# EasyEDA Pro project kuafu01_030内部老化方案.eprj, board PCB4 (continued)
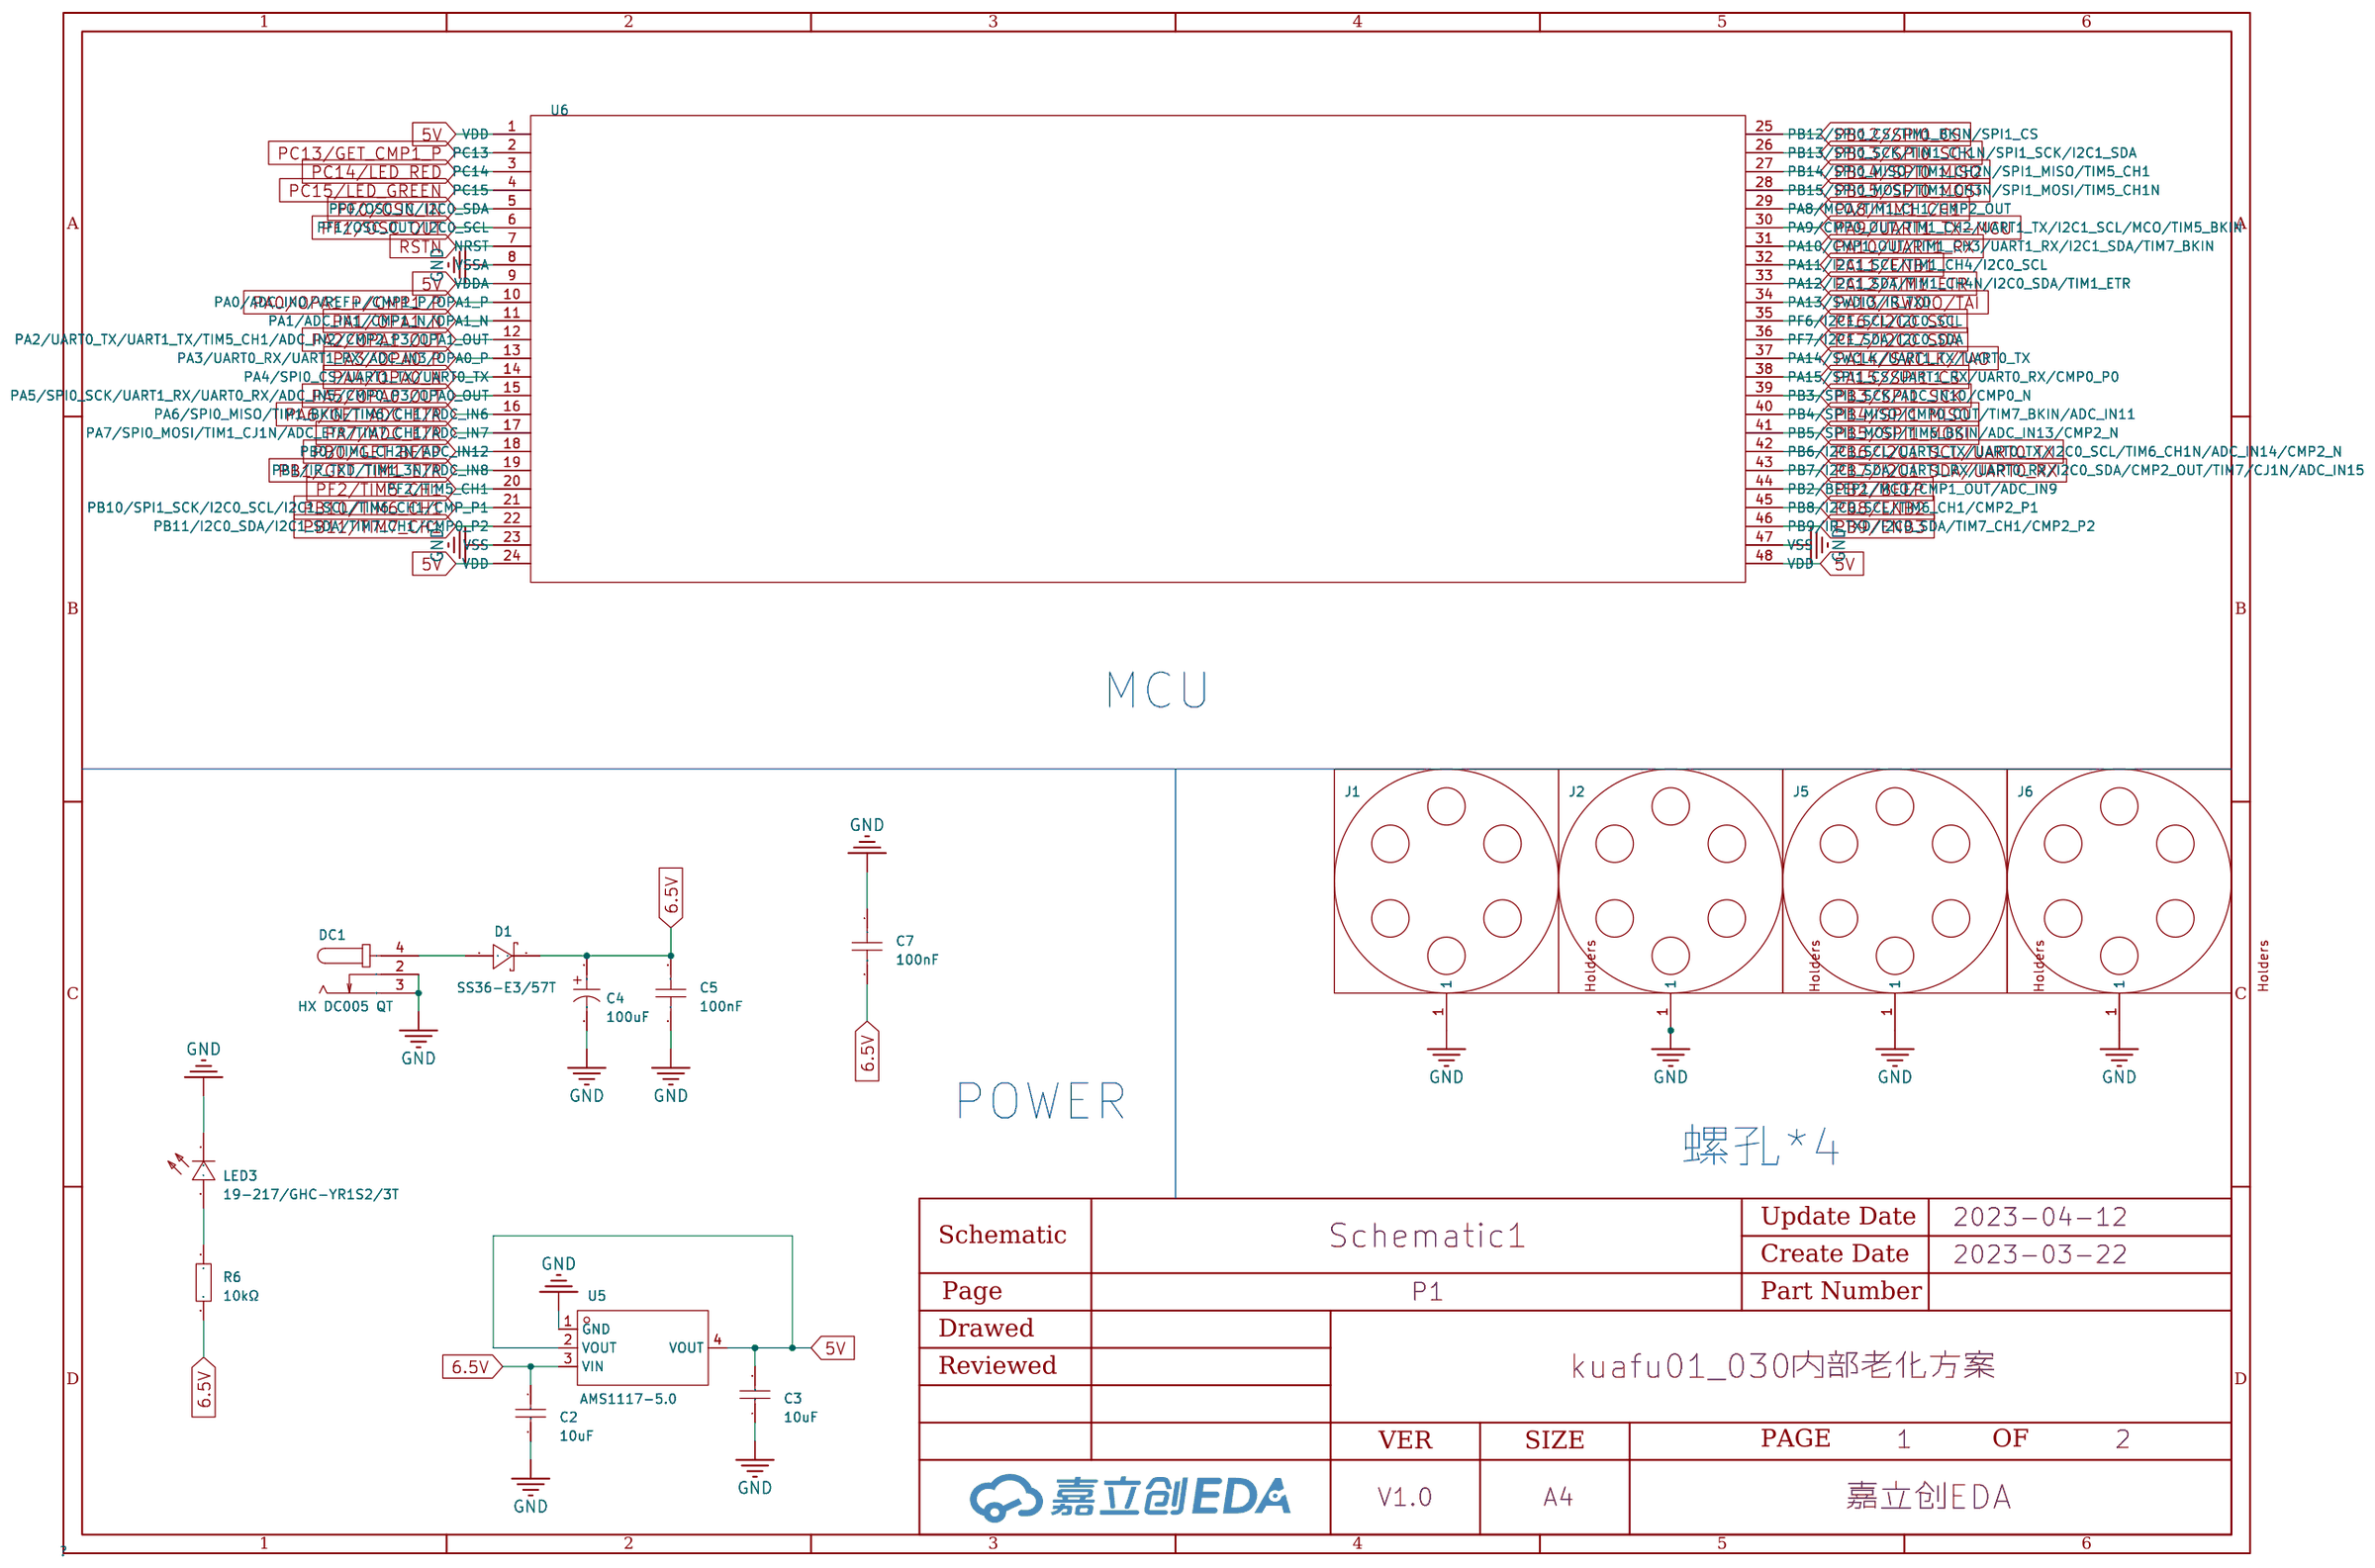
[diagram p0: P1]
## Routing (per net, layer and track width the routed paths; a pad name or vN(x,y) marks a point on that pad's centre or on a via; arc(x,y) is an arc through that point) (continued)
  vias: v1(27.43,288.04) v1(27.43,287.27) v1(27.43,286.51) v1(27.43,281.94) v1(27.43,281.18) v1(27.43,280.42) v1(27.43,274.32) v1(27.43,273.56) v1(27.43,272.8) v1(27.43,237.24) v1(27.43,236.47) v1(27.43,235.71) v1(27.43,231.14) v1(27.43,230.38) v1(27.43,229.62) v1(27.43,223.52) v1(27.43,222.76) v1(27.43,222) v1(27.43,186.44) v1(27.43,185.67) v1(27.43,184.91) v1(27.43,180.34) v1(27.43,179.58) v1(27.43,178.82) v1(27.43,172.72) v1(27.43,171.96) v1(27.43,171.2) v1(27.43,135.64) v1(27.43,134.87) v1(27.43,134.11) v1(27.43,129.54) v1(27.43,128.78) v1(27.43,128.02) v1(27.43,121.92) v1(27.43,121.16) v1(27.43,120.4) v1(27.43,84.84) v1(27.43,84.07) v1(27.43,83.31) v1(27.43,78.74) v1(27.43,77.98) v1(27.43,77.22) v1(27.43,71.12) v1(27.43,70.36) v1(27.43,69.6) v1(27.43,34.04) v1(27.43,33.27) v1(27.43,32.51) v1(27.43,27.94) v1(27.43,27.18) v1(27.43,26.42) v1(27.43,20.32) v1(27.43,19.56) v1(27.43,18.8) v1(28.19,288.04) v1(28.19,287.27) v1(28.19,286.51) v1(28.19,281.94) v1(28.19,281.18) v1(28.19,280.42) v1(28.19,274.32) v1(28.19,273.56) v1(28.19,272.8) v1(28.19,237.24) v1(28.19,236.47) v1(28.19,235.71) v1(28.19,231.14) v1(28.19,230.38) v1(28.19,229.62) v1(28.19,223.52) v1(28.19,222.76) v1(28.19,222) v1(28.19,186.44) v1(28.19,185.67) v1(28.19,184.91) v1(28.19,180.34) v1(28.19,179.58) v1(28.19,178.82) v1(28.19,172.72) v1(28.19,171.96) v1(28.19,171.2) v1(28.19,135.64) v1(28.19,134.87) v1(28.19,134.11) v1(28.19,129.54) v1(28.19,128.78) v1(28.19,128.02) v1(28.19,121.92) v1(28.19,121.16) v1(28.19,120.4) v1(28.19,84.84) v1(28.19,84.07) v1(28.19,83.31) v1(28.19,78.74) v1(28.19,77.98) v1(28.19,77.22) v1(28.19,71.12) v1(28.19,70.36) v1(28.19,69.6) v1(28.19,34.04) v1(28.19,33.27) v1(28.19,32.51) v1(28.19,27.94) v1(28.19,27.18) v1(28.19,26.42) v1(28.19,20.32) v1(28.19,19.56) v1(28.19,18.8) v1(28.96,288.04) v1(28.96,287.27) v1(28.96,286.51) v1(28.96,281.94) v1(28.96,281.18) v1(28.96,280.42) v1(28.96,274.32) v1(28.96,273.56) v1(28.96,272.8) v1(28.96,237.24) v1(28.96,236.47) v1(28.96,235.71) v1(28.96,231.14) v1(28.96,230.38) v1(28.96,229.62) v1(28.96,223.52) v1(28.96,222.76) v1(28.96,222) v1(28.96,186.44) v1(28.96,185.67) v1(28.96,184.91) v1(28.96,180.34) v1(28.96,179.58) v1(28.96,178.82) v1(28.96,172.72) v1(28.96,171.96) v1(28.96,171.2) v1(28.96,135.64) v1(28.96,134.87) v1(28.96,134.11) v1(28.96,129.54) v1(28.96,128.78) v1(28.96,128.02) v1(28.96,121.92) v1(28.96,121.16) v1(28.96,120.4) v1(28.96,84.84) v1(28.96,84.07) v1(28.96,83.31) v1(28.96,78.74) v1(28.96,77.98) v1(28.96,77.22) v1(28.96,71.12) v1(28.96,70.36) v1(28.96,69.6) v1(28.96,34.04) v1(28.96,33.27) v1(28.96,32.51) v1(28.96,27.94) v1(28.96,27.18) v1(28.96,26.42) v1(28.96,20.32) v1(28.96,19.56) v1(28.96,18.8) v1(29.46,295.15) v1(29.46,294.39) v1(29.46,293.62) v1(29.46,244.35) v1(29.46,243.59) v1(29.46,242.82) v1(29.46,193.55) v1(29.46,192.79) v1(29.46,192.02) v1(29.46,142.75) v1(29.46,141.99) v1(29.46,141.22) v1(29.46,91.95) v1(29.46,91.19) v1(29.46,90.42) v1(29.46,41.15) v1(29.46,40.39) v1(29.46,39.62) v1(30.23,295.15) v1(30.23,294.39) v1(30.23,293.62) v1(30.23,244.35) v1(30.23,243.59) v1(30.23,242.82) v1(30.23,193.55) v1(30.23,192.79) v1(30.23,192.02) v1(30.23,142.75) v1(30.23,141.99) v1(30.23,141.22) v1(30.23,91.95) v1(30.23,91.19) v1(30.23,90.42) v1(30.23,41.15) v1(30.23,40.39) v1(30.23,39.62) v1(30.99,301.24) v1(30.99,300.48) v1(30.99,299.72) v1(30.99,295.15) v1(30.99,294.39) v1(30.99,293.62) v1(30.99,250.44) v1(30.99,249.68) v1(30.99,248.92) v1(30.99,244.35) v1(30.99,243.59) v1(30.99,242.82) v1(30.99,199.64) v1(30.99,198.88) v1(30.99,198.12) v1(30.99,193.55) v1(30.99,192.79) v1(30.99,192.02) v1(30.99,148.84) v1(30.99,148.08) v1(30.99,147.32) v1(30.99,142.75) v1(30.99,141.99) v1(30.99,141.22) v1(30.99,98.04) v1(30.99,97.28) v1(30.99,96.52) v1(30.99,91.95) v1(30.99,91.19) v1(30.99,90.42) v1(30.99,47.24) v1(30.99,46.48) v1(30.99,45.72) v1(30.99,41.15) v1(30.99,40.39) v1(30.99,39.62) v1(31.75,301.24) v1(31.75,300.48) v1(31.75,299.72) v1(31.75,250.44) v1(31.75,249.68) v1(31.75,248.92) v1(31.75,199.64) v1(31.75,198.88) v1(31.75,198.12) v1(31.75,148.84) v1(31.75,148.08) v1(31.75,147.32) v1(31.75,98.04) v1(31.75,97.28) v1(31.75,96.52) v1(31.75,47.24) v1(31.75,46.48) v1(31.75,45.72) v1(32.51,301.24) v1(32.51,300.48) v1(32.51,299.72) v1(32.51,250.44) v1(32.51,249.68) v1(32.51,248.92) v1(32.51,199.64) v1(32.51,198.88) v1(32.51,198.12) v1(32.51,148.84) v1(32.51,148.08) v1(32.51,147.32) v1(32.51,98.04) v1(32.51,97.28) v1(32.51,96.52) v1(32.51,47.24) v1(32.51,46.48) v1(32.51,45.72) v1(33.02,307.34) v1(33.02,306.58) v1(33.02,305.82) v1(33.02,268.22) v1(33.02,267.46) v1(33.02,266.7) v1(33.02,256.54) v1(33.02,255.78) v1(33.02,255.02) v1(33.02,217.42) v1(33.02,216.66) v1(33.02,215.9) v1(33.02,205.74) v1(33.02,204.98) v1(33.02,204.22) v1(33.02,166.62) v1(33.02,165.86) v1(33.02,165.1) v1(33.02,154.94) v1(33.02,154.18) v1(33.02,153.42) v1(33.02,115.82) v1(33.02,115.06) v1(33.02,114.3) v1(33.02,104.14) v1(33.02,103.38) v1(33.02,102.62) v1(33.02,65.02) v1(33.02,64.26) v1(33.02,63.5) v1(33.02,53.34) v1(33.02,52.58) v1(33.02,51.82) v1(33.02,14.22) v1(33.02,13.46) v1(33.02,12.7) v1(33.78,307.34) v1(33.78,306.58) v1(33.78,305.82) v1(33.78,268.22) v1(33.78,267.46) v1(33.78,266.7) v1(33.78,256.54) v1(33.78,255.78) v1(33.78,255.02) v1(33.78,217.42) v1(33.78,216.66) v1(33.78,215.9) v1(33.78,205.74) v1(33.78,204.98) v1(33.78,204.22) v1(33.78,166.62) v1(33.78,165.86) v1(33.78,165.1) v1(33.78,154.94) v1(33.78,154.18) v1(33.78,153.42) v1(33.78,115.82) v1(33.78,115.06) v1(33.78,114.3) v1(33.78,104.14) v1(33.78,103.38) v1(33.78,102.62) v1(33.78,65.02) v1(33.78,64.26) v1(33.78,63.5) v1(33.78,53.34) v1(33.78,52.58) v1(33.78,51.82) v1(33.78,14.22) v1(33.78,13.46) v1(33.78,12.7) v1(34.54,307.34) v1(34.54,306.58) v1(34.54,305.82) v1(34.54,268.22) v1(34.54,267.46) v1(34.54,266.7) v1(34.54,256.54) v1(34.54,255.78) v1(34.54,255.02) v1(34.54,217.42) v1(34.54,216.66) v1(34.54,215.9) v1(34.54,205.74) v1(34.54,204.98) v1(34.54,204.22) v1(34.54,166.62) v1(34.54,165.86) v1(34.54,165.1) v1(34.54,154.94) v1(34.54,154.18) v1(34.54,153.42) v1(34.54,115.82) v1(34.54,115.06) v1(34.54,114.3) v1(34.54,104.14) v1(34.54,103.38) v1(34.54,102.62) v1(34.54,65.02) v1(34.54,64.26) v1(34.54,63.5) v1(34.54,53.34) v1(34.54,52.58) v1(34.54,51.82) v1(34.54,14.22) v1(34.54,13.46) v1(34.54,12.7) v1(62.99,307.34) v1(62.99,306.58) v1(62.99,305.82) v1(62.99,268.22) v1(62.99,267.46) v1(62.99,266.7) v1(62.99,256.54) v1(62.99,255.78) v1(62.99,255.02) v1(62.99,217.42) v1(62.99,216.66) v1(62.99,215.9) v1(62.99,205.74) v1(62.99,204.98) v1(62.99,204.22) v1(62.99,166.62) v1(62.99,165.86) v1(62.99,165.1) v1(62.99,154.94) v1(62.99,154.18) v1(62.99,153.42) v1(62.99,115.82) v1(62.99,115.06) v1(62.99,114.3) v1(62.99,104.14) v1(62.99,103.38) v1(62.99,102.62) v1(62.99,65.02) v1(62.99,64.26) v1(62.99,63.5) v1(62.99,53.34) v1(62.99,52.58) v1(62.99,51.82) v1(62.99,14.22) v1(62.99,13.46) v1(62.99,12.7) v1(63.75,307.34) v1(63.75,306.58) v1(63.75,305.82) v1(63.75,268.22) v1(63.75,267.46) v1(63.75,266.7) v1(63.75,256.54) v1(63.75,255.78) v1(63.75,255.02) v1(63.75,217.42) v1(63.75,216.66) v1(63.75,215.9) v1(63.75,205.74) v1(63.75,204.98) v1(63.75,204.22) v1(63.75,166.62) v1(63.75,165.86) v1(63.75,165.1) v1(63.75,154.94) v1(63.75,154.18) v1(63.75,153.42) v1(63.75,115.82) v1(63.75,115.06) v1(63.75,114.3) v1(63.75,104.14) v1(63.75,103.38) v1(63.75,102.62) v1(63.75,65.02) v1(63.75,64.26) v1(63.75,63.5) v1(63.75,53.34) v1(63.75,52.58) v1(63.75,51.82) v1(63.75,14.22) v1(63.75,13.46) v1(63.75,12.7) v1(64.52,307.34) v1(64.52,306.58) v1(64.52,305.82) v1(64.52,268.22) v1(64.52,267.46) v1(64.52,266.7) v1(64.52,256.54) v1(64.52,255.78) v1(64.52,255.02) v1(64.52,217.42) v1(64.52,216.66) v1(64.52,215.9) v1(64.52,205.74) v1(64.52,204.98) v1(64.52,204.22) v1(64.52,166.62) v1(64.52,165.86) v1(64.52,165.1) v1(64.52,154.94) v1(64.52,154.18) v1(64.52,153.42) v1(64.52,115.82) v1(64.52,115.06) v1(64.52,114.3) v1(64.52,104.14) v1(64.52,103.38) v1(64.52,102.62) v1(64.52,65.02) v1(64.52,64.26) v1(64.52,63.5) v1(64.52,53.34) v1(64.52,52.58) v1(64.52,51.82) v1(64.52,14.22) v1(64.52,13.46) v1(64.52,12.7) v1(65.53,301.24) v1(65.53,300.48) v1(65.53,299.72) v1(65.53,250.44) v1(65.53,249.68) v1(65.53,248.92) v1(65.53,199.64) v1(65.53,198.88) v1(65.53,198.12) v1(65.53,148.84) v1(65.53,148.08) v1(65.53,147.32) v1(65.53,98.04) v1(65.53,97.28) v1(65.53,96.52) v1(65.53,47.24) v1(65.53,46.48) v1(65.53,45.72) v1(66.29,301.24) v1(66.29,300.48) v1(66.29,299.72) v1(66.29,250.44) v1(66.29,249.68) v1(66.29,248.92) v1(66.29,199.64) v1(66.29,198.88) v1(66.29,198.12) v1(66.29,148.84) v1(66.29,148.08) v1(66.29,147.32) v1(66.29,98.04) v1(66.29,97.28) v1(66.29,96.52) v1(66.29,47.24) v1(66.29,46.48) v1(66.29,45.72) v1(67.06,301.24) v1(67.06,300.48) v1(67.06,299.72) v1(67.06,250.44) v1(67.06,249.68) v1(67.06,248.92) v1(67.06,199.64) v1(67.06,198.88) v1(67.06,198.12) v1(67.06,148.84) v1(67.06,148.08) v1(67.06,147.32) v1(67.06,98.04) v1(67.06,97.28) v1(67.06,96.52) v1(67.06,47.24) v1(67.06,46.48) v1(67.06,45.72) v1(68.58,295.15) v1(68.58,294.39) v1(68.58,293.62) v1(68.58,272.8) v1(68.58,272.03) v1(68.58,271.27) v1(68.58,244.35) v1(68.58,243.59) v1(68.58,242.82) v1(68.58,222) v1(68.58,221.23) v1(68.58,220.47) v1(68.58,193.55) v1(68.58,192.79) v1(68.58,192.02) v1(68.58,171.2) v1(68.58,170.43) v1(68.58,169.67) v1(68.58,142.75) v1(68.58,141.99) v1(68.58,141.22) v1(68.58,120.4) v1(68.58,119.63) v1(68.58,118.87) v1(68.58,91.95) v1(68.58,91.19) v1(68.58,90.42) v1(68.58,69.6) v1(68.58,68.83) v1(68.58,68.07) v1(68.58,41.15) v1(68.58,40.39) v1(68.58,39.62) v1(68.58,18.8) v1(68.58,18.03) v1(68.58,17.27) v1(69.34,295.15) v1(69.34,294.39) v1(69.34,293.62) v1(69.34,272.8) v1(69.34,272.03) v1(69.34,271.27) v1(69.34,244.35) v1(69.34,243.59) v1(69.34,242.82) v1(69.34,222) v1(69.34,221.23) v1(69.34,220.47) v1(69.34,193.55) v1(69.34,192.79) v1(69.34,192.02) v1(69.34,171.2) v1(69.34,170.43) v1(69.34,169.67) v1(69.34,142.75) v1(69.34,141.99) v1(69.34,141.22) v1(69.34,120.4) v1(69.34,119.63) v1(69.34,118.87) v1(69.34,91.95) v1(69.34,91.19) v1(69.34,90.42) v1(69.34,69.6) v1(69.34,68.83) v1(69.34,68.07) v1(69.34,41.15) v1(69.34,40.39) v1(69.34,39.62) v1(69.34,18.8) v1(69.34,18.03) v1(69.34,17.27) v1(70.1,295.15) v1(70.1,294.39) v1(70.1,293.62) v1(70.1,272.8) v1(70.1,272.03) v1(70.1,271.27) v1(70.1,244.35) v1(70.1,243.59) v1(70.1,242.82) v1(70.1,222) v1(70.1,221.23) v1(70.1,220.47) v1(70.1,193.55) v1(70.1,192.79) v1(70.1,192.02) v1(70.1,171.2) v1(70.1,170.43) v1(70.1,169.67) v1(70.1,142.75) v1(70.1,141.99) v1(70.1,141.22) v1(70.1,120.4) v1(70.1,119.63) v1(70.1,118.87) v1(70.1,91.95) v1(70.1,91.19) v1(70.1,90.42) v1(70.1,69.6) v1(70.1,68.83) v1(70.1,68.07) v1(70.1,41.15) v1(70.1,40.39) v1(70.1,39.62) v1(70.1,18.8) v1(70.1,18.03) v1(70.1,17.27) v1(71.63,288.04) v1(71.63,287.27) v1(71.63,286.51) v1(71.63,278.38) v1(71.63,277.62) v1(71.63,276.86) v1(71.63,237.24) v1(71.63,236.47) v1(71.63,235.71) v1(71.63,227.58) v1(71.63,226.82) v1(71.63,226.06) v1(71.63,186.44) v1(71.63,185.67) v1(71.63,184.91) v1(71.63,176.78) v1(71.63,176.02) v1(71.63,175.26) v1(71.63,135.64) v1(71.63,134.87) v1(71.63,134.11) v1(71.63,125.98) v1(71.63,125.22) v1(71.63,124.46) v1(71.63,84.84) v1(71.63,84.07) v1(71.63,83.31) v1(71.63,75.18) v1(71.63,74.42) v1(71.63,73.66) v1(71.63,34.04) v1(71.63,33.27) v1(71.63,32.51) v1(71.63,24.38) v1(71.63,23.62) v1(71.63,22.86) v1(72.39,288.04) v1(72.39,287.27) v1(72.39,286.51) v1(72.39,278.38) v1(72.39,277.62) v1(72.39,276.86) v1(72.39,237.24) v1(72.39,236.47) v1(72.39,235.71) v1(72.39,227.58) v1(72.39,226.82) v1(72.39,226.06) v1(72.39,186.44) v1(72.39,185.67) v1(72.39,184.91) v1(72.39,176.78) v1(72.39,176.02) v1(72.39,175.26) v1(72.39,135.64) v1(72.39,134.87) v1(72.39,134.11) v1(72.39,125.98) v1(72.39,125.22) v1(72.39,124.46) v1(72.39,84.84) v1(72.39,84.07) v1(72.39,83.31) v1(72.39,75.18) v1(72.39,74.42) v1(72.39,73.66) v1(72.39,34.04) v1(72.39,33.27) v1(72.39,32.51) v1(72.39,24.38) v1(72.39,23.62) v1(72.39,22.86) v1(73.15,288.04) v1(73.15,287.27) v1(73.15,286.51) v1(73.15,278.38) v1(73.15,277.62) v1(73.15,276.86) v1(73.15,237.24) v1(73.15,236.47) v1(73.15,235.71) v1(73.15,227.58) v1(73.15,226.82) v1(73.15,226.06) v1(73.15,186.44) v1(73.15,185.67) v1(73.15,184.91) v1(73.15,176.78) v1(73.15,176.02) v1(73.15,175.26) v1(73.15,135.64) v1(73.15,134.87) v1(73.15,134.11) v1(73.15,125.98) v1(73.15,125.22) v1(73.15,124.46) v1(73.15,84.84) v1(73.15,84.07) v1(73.15,83.31) v1(73.15,75.18) v1(73.15,74.42) v1(73.15,73.66) v1(73.15,34.04) v1(73.15,33.27) v1(73.15,32.51) v1(73.15,24.38) v1(73.15,23.62) v1(73.15,22.86) v1(78.23,338.84) v1(78.23,338.07) v1(78.23,337.31) v1(78.23,332.74) v1(78.23,331.98) v1(78.23,331.22) v1(78.23,325.12) v1(78.23,324.36) v1(78.23,323.6) v1(78.23,288.04) v1(78.23,287.27) v1(78.23,286.51) v1(78.23,281.94) v1(78.23,281.18) v1(78.23,280.42) v1(78.23,274.32) v1(78.23,273.56) v1(78.23,272.8) v1(78.23,237.24) v1(78.23,236.47) v1(78.23,235.71) v1(78.23,231.14) v1(78.23,230.38) v1(78.23,229.62) v1(78.23,223.52) v1(78.23,222.76) v1(78.23,222) v1(78.23,186.44) v1(78.23,185.67) v1(78.23,184.91) v1(78.23,180.34) v1(78.23,179.58) v1(78.23,178.82) v1(78.23,172.72) v1(78.23,171.96) v1(78.23,171.2) v1(78.23,135.64) v1(78.23,134.87) v1(78.23,134.11) v1(78.23,129.54) v1(78.23,128.78) v1(78.23,128.02) v1(78.23,121.92) v1(78.23,121.16) v1(78.23,120.4) v1(78.23,84.84) v1(78.23,84.07) v1(78.23,83.31) v1(78.23,78.74) v1(78.23,77.98) v1(78.23,77.22) v1(78.23,71.12) v1(78.23,70.36) v1(78.23,69.6) v1(78.23,34.04) v1(78.23,33.27) v1(78.23,32.51) v1(78.23,27.94) v1(78.23,27.18) v1(78.23,26.42) v1(78.23,20.32) v1(78.23,19.56) v1(78.23,18.8) v1(78.99,338.84) v1(78.99,338.07) v1(78.99,337.31) v1(78.99,332.74) v1(78.99,331.98) v1(78.99,331.22) v1(78.99,325.12) v1(78.99,324.36) v1(78.99,323.6) v1(78.99,288.04) v1(78.99,287.27) v1(78.99,286.51) v1(78.99,281.94) v1(78.99,281.18) v1(78.99,280.42) v1(78.99,274.32) v1(78.99,273.56) v1(78.99,272.8) v1(78.99,237.24) v1(78.99,236.47) v1(78.99,235.71) v1(78.99,231.14) v1(78.99,230.38) v1(78.99,229.62) v1(78.99,223.52) v1(78.99,222.76) v1(78.99,222) v1(78.99,186.44) v1(78.99,185.67) v1(78.99,184.91) v1(78.99,180.34) v1(78.99,179.58) v1(78.99,178.82) v1(78.99,172.72) v1(78.99,171.96) v1(78.99,171.2) v1(78.99,135.64) v1(78.99,134.87) v1(78.99,134.11) v1(78.99,129.54) v1(78.99,128.78) v1(78.99,128.02) v1(78.99,121.92) v1(78.99,121.16) v1(78.99,120.4) v1(78.99,84.84) v1(78.99,84.07) v1(78.99,83.31) v1(78.99,78.74) v1(78.99,77.98) v1(78.99,77.22) v1(78.99,71.12) v1(78.99,70.36) v1(78.99,69.6) v1(78.99,34.04) v1(78.99,33.27) v1(78.99,32.51) v1(78.99,27.94) v1(78.99,27.18) v1(78.99,26.42) v1(78.99,20.32) v1(78.99,19.56) v1(78.99,18.8) v1(79.76,338.84) v1(79.76,338.07) v1(79.76,337.31) v1(79.76,332.74) v1(79.76,331.98) v1(79.76,331.22) v1(79.76,325.12) v1(79.76,324.36) v1(79.76,323.6) v1(79.76,288.04) v1(79.76,287.27) v1(79.76,286.51) v1(79.76,281.94) v1(79.76,281.18) v1(79.76,280.42) v1(79.76,274.32) v1(79.76,273.56) v1(79.76,272.8) v1(79.76,237.24) v1(79.76,236.47) v1(79.76,235.71) v1(79.76,231.14) v1(79.76,230.38) v1(79.76,229.62) v1(79.76,223.52) v1(79.76,222.76) v1(79.76,222) v1(79.76,186.44) v1(79.76,185.67) v1(79.76,184.91) v1(79.76,180.34) v1(79.76,179.58) v1(79.76,178.82) v1(79.76,172.72) v1(79.76,171.96) v1(79.76,171.2) v1(79.76,135.64) v1(79.76,134.87) v1(79.76,134.11) v1(79.76,129.54) v1(79.76,128.78) v1(79.76,128.02) v1(79.76,121.92) v1(79.76,121.16) v1(79.76,120.4) v1(79.76,84.84) v1(79.76,84.07) v1(79.76,83.31) v1(79.76,78.74) v1(79.76,77.98) v1(79.76,77.22) v1(79.76,71.12) v1(79.76,70.36) v1(79.76,69.6) v1(79.76,34.04) v1(79.76,33.27) v1(79.76,32.51) v1(79.76,27.94) v1(79.76,27.18) v1(79.76,26.42) v1(79.76,20.32) v1(79.76,19.56) v1(79.76,18.8) v1(80.26,345.95) v1(80.26,345.19) v1(80.26,344.42) v1(80.26,295.15) v1(80.26,294.39) v1(80.26,293.62) v1(80.26,244.35) v1(80.26,243.59) v1(80.26,242.82) v1(80.26,193.55) v1(80.26,192.79) v1(80.26,192.02) v1(80.26,142.75) v1(80.26,141.99) v1(80.26,141.22) v1(80.26,91.95) v1(80.26,91.19) v1(80.26,90.42) v1(80.26,41.15) v1(80.26,40.39) v1(80.26,39.62) v1(81.03,345.95) v1(81.03,345.19) v1(81.03,344.42) v1(81.03,295.15) v1(81.03,294.39) v1(81.03,293.62) v1(81.03,244.35) v1(81.03,243.59) v1(81.03,242.82) v1(81.03,193.55) v1(81.03,192.79) v1(81.03,192.02) v1(81.03,142.75) v1(81.03,141.99) v1(81.03,141.22) v1(81.03,91.95) v1(81.03,91.19) v1(81.03,90.42) v1(81.03,41.15) v1(81.03,40.39) v1(81.03,39.62) v1(81.79,352.04) v1(81.79,351.28) v1(81.79,350.52) v1(81.79,345.95) v1(81.79,345.19) v1(81.79,344.42) v1(81.79,301.24) v1(81.79,300.48) v1(81.79,299.72) v1(81.79,295.15) v1(81.79,294.39) v1(81.79,293.62) v1(81.79,250.44) v1(81.79,249.68) v1(81.79,248.92) v1(81.79,244.35) v1(81.79,243.59) v1(81.79,242.82) v1(81.79,199.64) v1(81.79,198.88) v1(81.79,198.12) v1(81.79,193.55) v1(81.79,192.79) v1(81.79,192.02) v1(81.79,148.84) v1(81.79,148.08) v1(81.79,147.32) v1(81.79,142.75) v1(81.79,141.99) v1(81.79,141.22) v1(81.79,98.04) v1(81.79,97.28) v1(81.79,96.52) v1(81.79,91.95) v1(81.79,91.19) v1(81.79,90.42) v1(81.79,47.24) v1(81.79,46.48) v1(81.79,45.72) v1(81.79,41.15) v1(81.79,40.39) v1(81.79,39.62) v1(82.55,352.04) v1(82.55,351.28) v1(82.55,350.52) v1(82.55,301.24) v1(82.55,300.48) v1(82.55,299.72) v1(82.55,250.44) v1(82.55,249.68) v1(82.55,248.92) v1(82.55,199.64) v1(82.55,198.88) v1(82.55,198.12) v1(82.55,148.84) v1(82.55,148.08) v1(82.55,147.32) v1(82.55,98.04) v1(82.55,97.28) v1(82.55,96.52) v1(82.55,47.24) v1(82.55,46.48) v1(82.55,45.72) v1(83.31,352.04) v1(83.31,351.28) v1(83.31,350.52) v1(83.31,301.24) v1(83.31,300.48) v1(83.31,299.72) v1(83.31,250.44) v1(83.31,249.68) v1(83.31,248.92) v1(83.31,199.64) v1(83.31,198.88) v1(83.31,198.12) v1(83.31,148.84) v1(83.31,148.08) v1(83.31,147.32) v1(83.31,98.04) v1(83.31,97.28) v1(83.31,96.52) v1(83.31,47.24) v1(83.31,46.48) v1(83.31,45.72) v1(83.82,319.02) v1(83.82,318.26) v1(83.82,317.5) v1(83.82,307.34) v1(83.82,306.58) v1(83.82,305.82) v1(83.82,268.22) v1(83.82,267.46) v1(83.82,266.7) v1(83.82,256.54) v1(83.82,255.78) v1(83.82,255.02) v1(83.82,217.42) v1(83.82,216.66) v1(83.82,215.9) v1(83.82,205.74) v1(83.82,204.98) v1(83.82,204.22) v1(83.82,166.62) v1(83.82,165.86) v1(83.82,165.1) v1(83.82,154.94) v1(83.82,154.18) v1(83.82,153.42) v1(83.82,115.82) v1(83.82,115.06) v1(83.82,114.3) v1(83.82,104.14) v1(83.82,103.38) v1(83.82,102.62) v1(83.82,65.02) v1(83.82,64.26) v1(83.82,63.5) v1(83.82,53.34) v1(83.82,52.58) v1(83.82,51.82) v1(83.82,14.22) v1(83.82,13.46) v1(83.82,12.7) v1(84.58,319.02) v1(84.58,318.26) v1(84.58,317.5) v1(84.58,307.34) v1(84.58,306.58) v1(84.58,305.82) v1(84.58,268.22) v1(84.58,267.46) v1(84.58,266.7) v1(84.58,256.54) v1(84.58,255.78) v1(84.58,255.02) v1(84.58,217.42) v1(84.58,216.66) v1(84.58,215.9) v1(84.58,205.74) v1(84.58,204.98) v1(84.58,204.22) v1(84.58,166.62) v1(84.58,165.86) v1(84.58,165.1) v1(84.58,154.94) v1(84.58,154.18) v1(84.58,153.42) v1(84.58,115.82) v1(84.58,115.06) v1(84.58,114.3) v1(84.58,104.14) v1(84.58,103.38) v1(84.58,102.62) v1(84.58,65.02) v1(84.58,64.26) v1(84.58,63.5) v1(84.58,53.34) v1(84.58,52.58) v1(84.58,51.82) v1(84.58,14.22) v1(84.58,13.46) v1(84.58,12.7) v1(85.34,319.02) v1(85.34,318.26) v1(85.34,317.5) v1(85.34,307.34) v1(85.34,306.58) v1(85.34,305.82) v1(85.34,268.22) v1(85.34,267.46) v1(85.34,266.7) v1(85.34,256.54) v1(85.34,255.78) v1(85.34,255.02) v1(85.34,217.42) v1(85.34,216.66) v1(85.34,215.9) v1(85.34,205.74) v1(85.34,204.98) v1(85.34,204.22) v1(85.34,166.62) v1(85.34,165.86) v1(85.34,165.1) v1(85.34,154.94) v1(85.34,154.18) v1(85.34,153.42) v1(85.34,115.82) v1(85.34,115.06) v1(85.34,114.3) v1(85.34,104.14) v1(85.34,103.38) v1(85.34,102.62) v1(85.34,65.02) v1(85.34,64.26) v1(85.34,63.5) v1(85.34,53.34) v1(85.34,52.58) v1(85.34,51.82) v1(85.34,14.22) v1(85.34,13.46) v1(85.34,12.7) v1(87.88,357.12) v1(87.88,356.36) v1(87.88,355.6) v1(88.65,357.12) v1(88.65,356.36) v1(88.65,355.6) v1(89.41,357.12) v1(89.41,356.36) v1(89.41,355.6) v1(113.79,358.14) v1(113.79,357.38) v1(113.79,356.62) v1(113.79,319.02) v1(113.79,318.26) v1(113.79,317.5) v1(113.79,307.34) v1(113.79,306.58) v1(113.79,305.82) v1(113.79,268.22) 